# Altium schematic sheet 控制板.SchDoc (part 1 of 2) (continued)
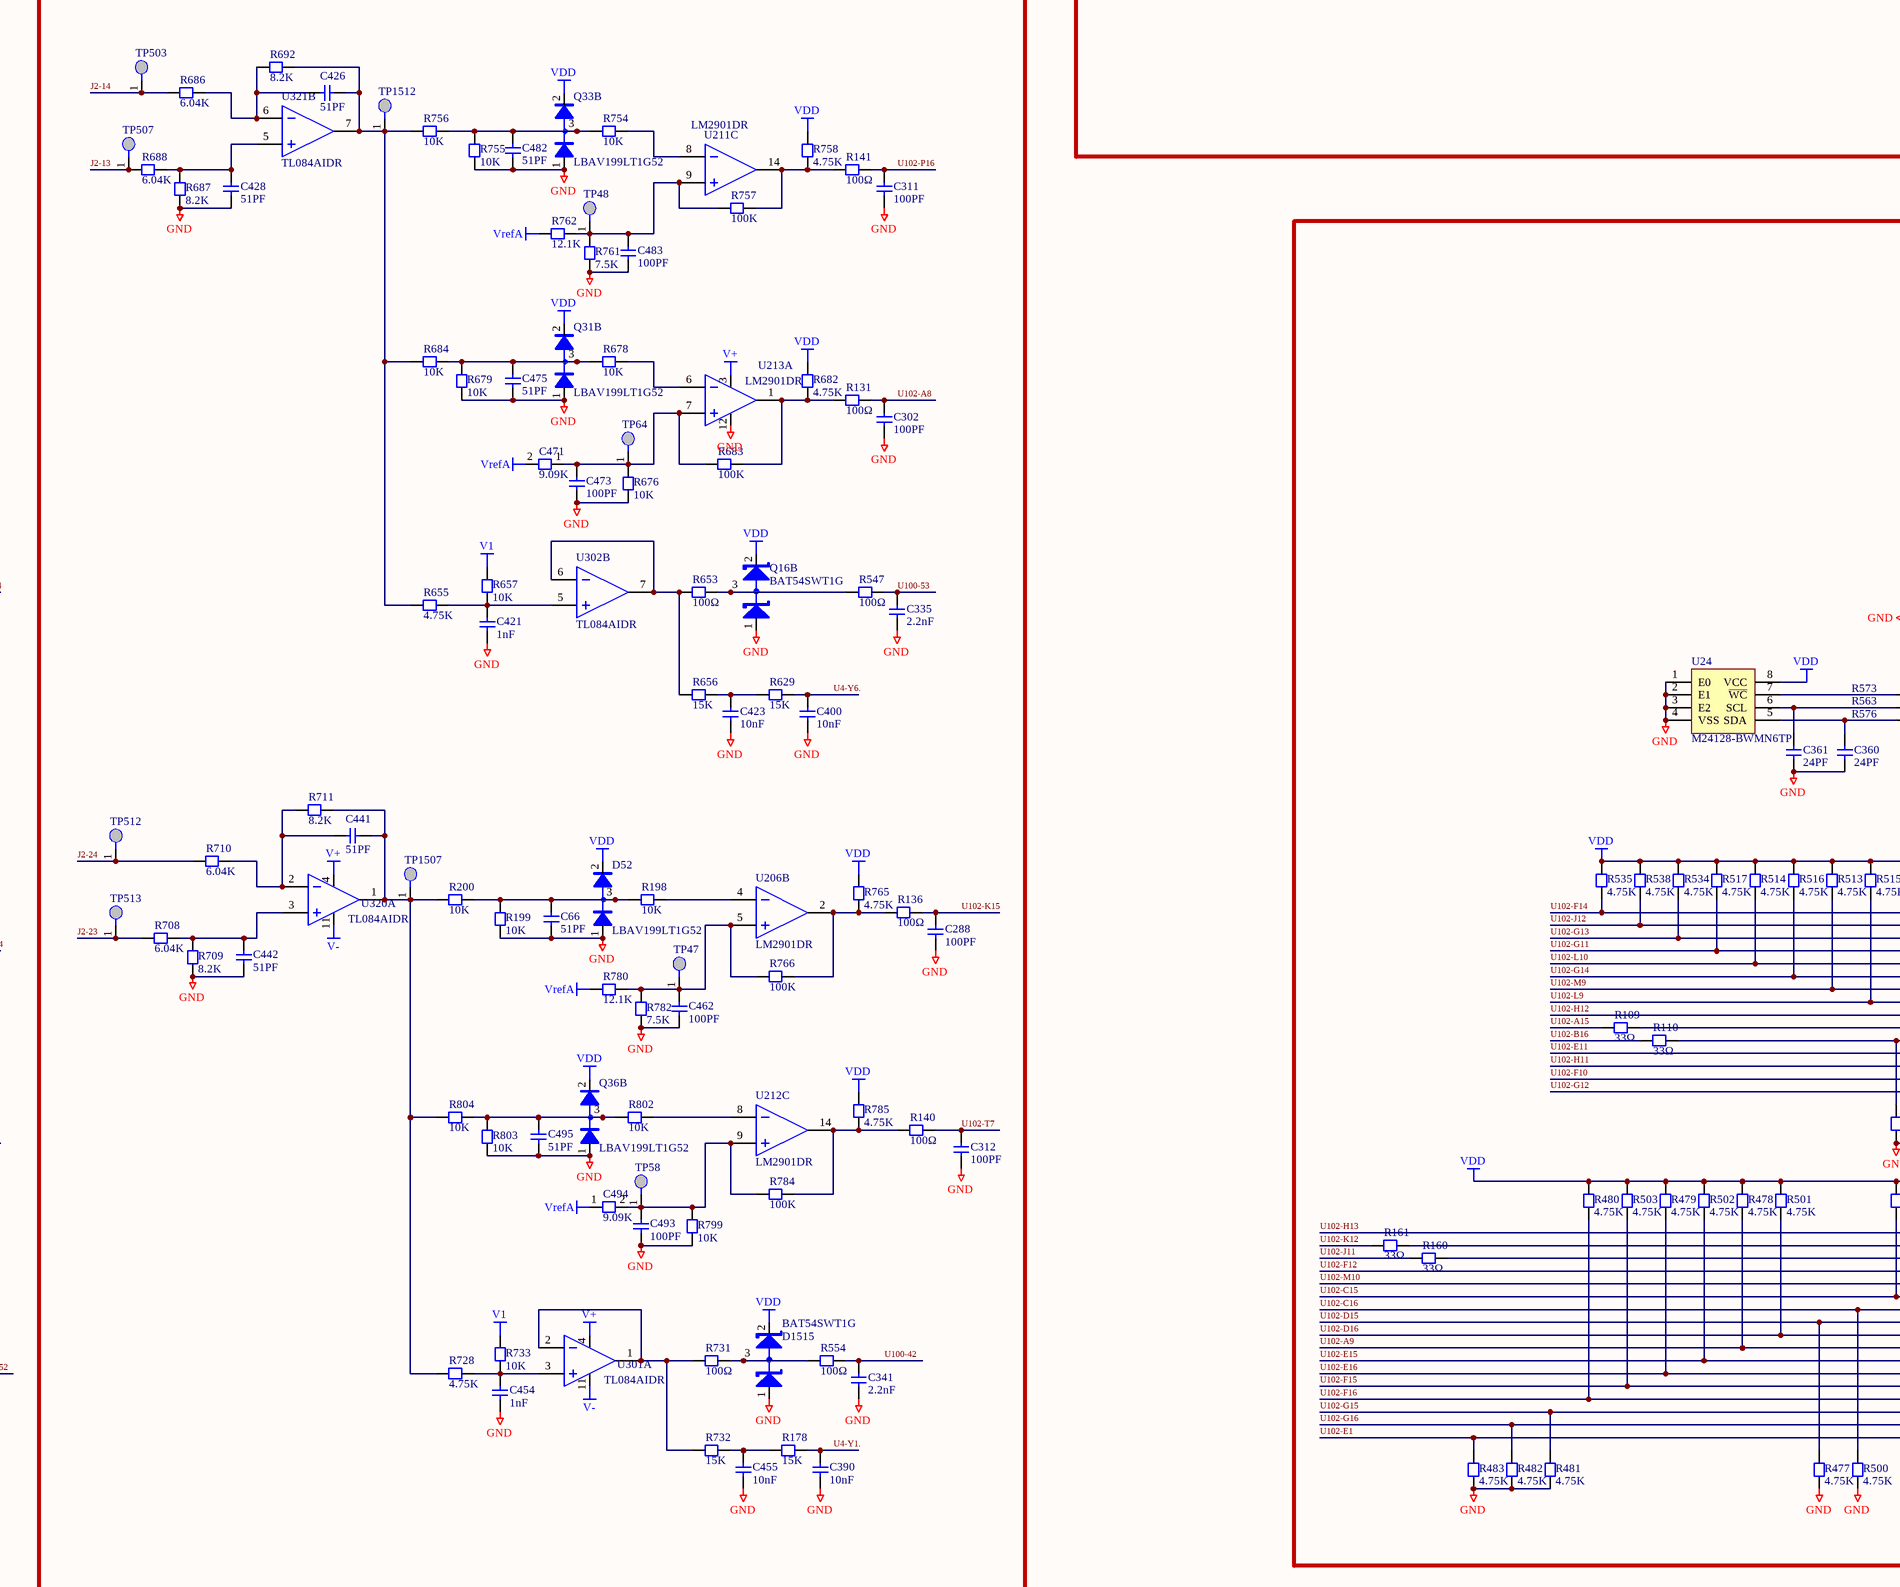
[diagram p5: 控制板.SchDoc, centre column 2 of 4]
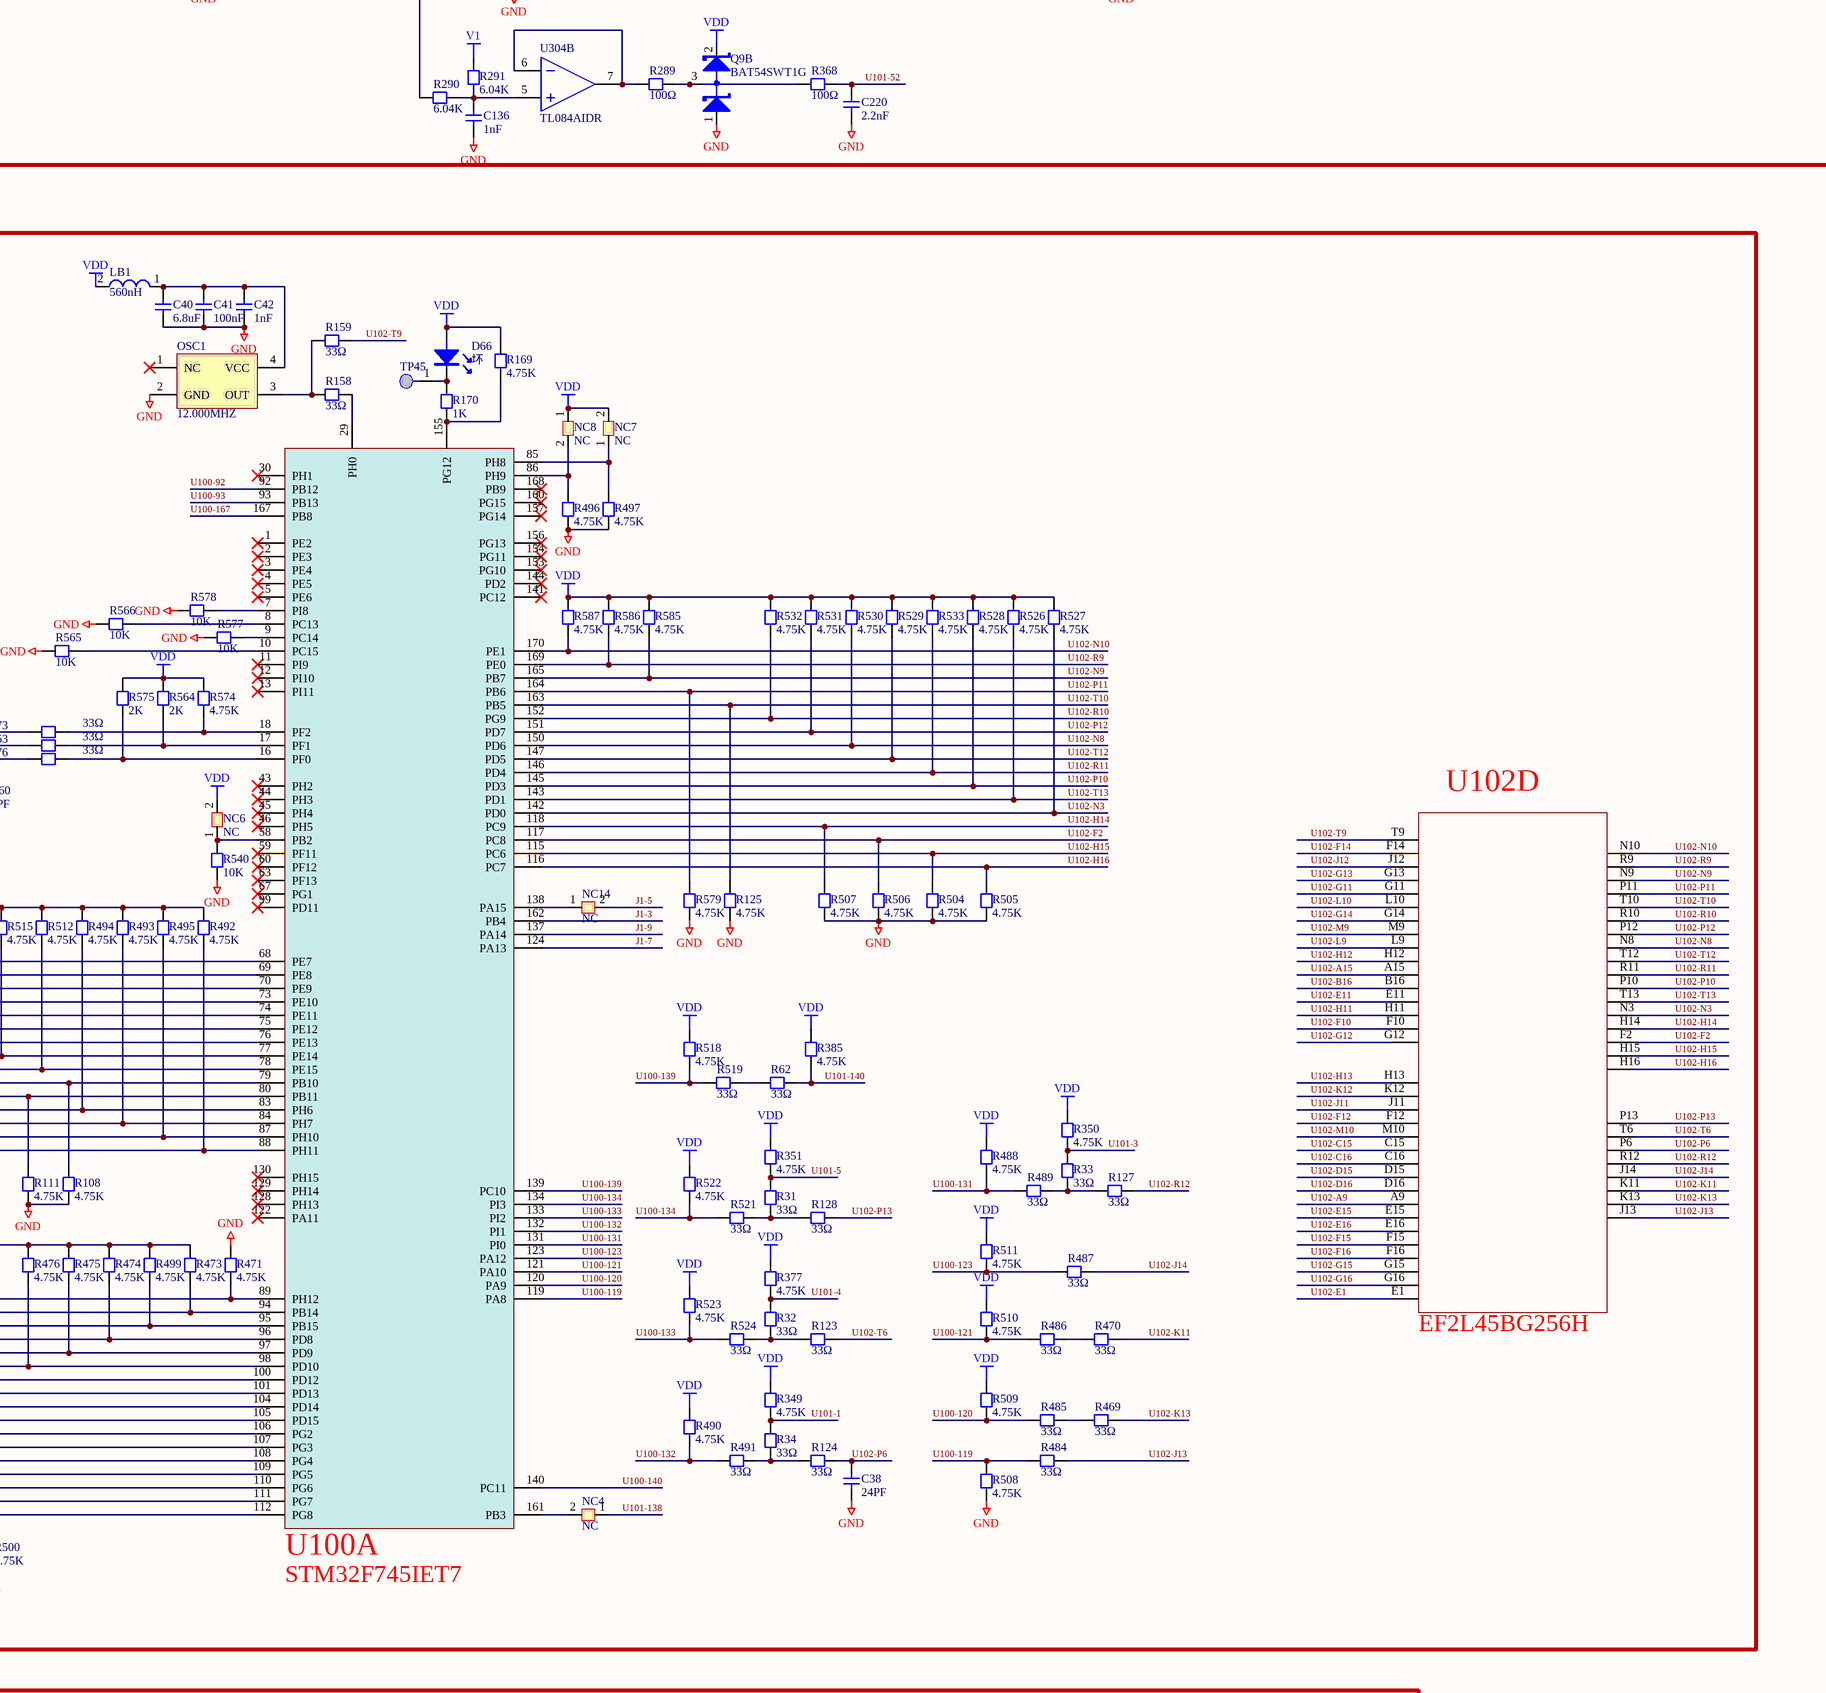
[diagram p6: 控制板.SchDoc, centre column 3 of 4]
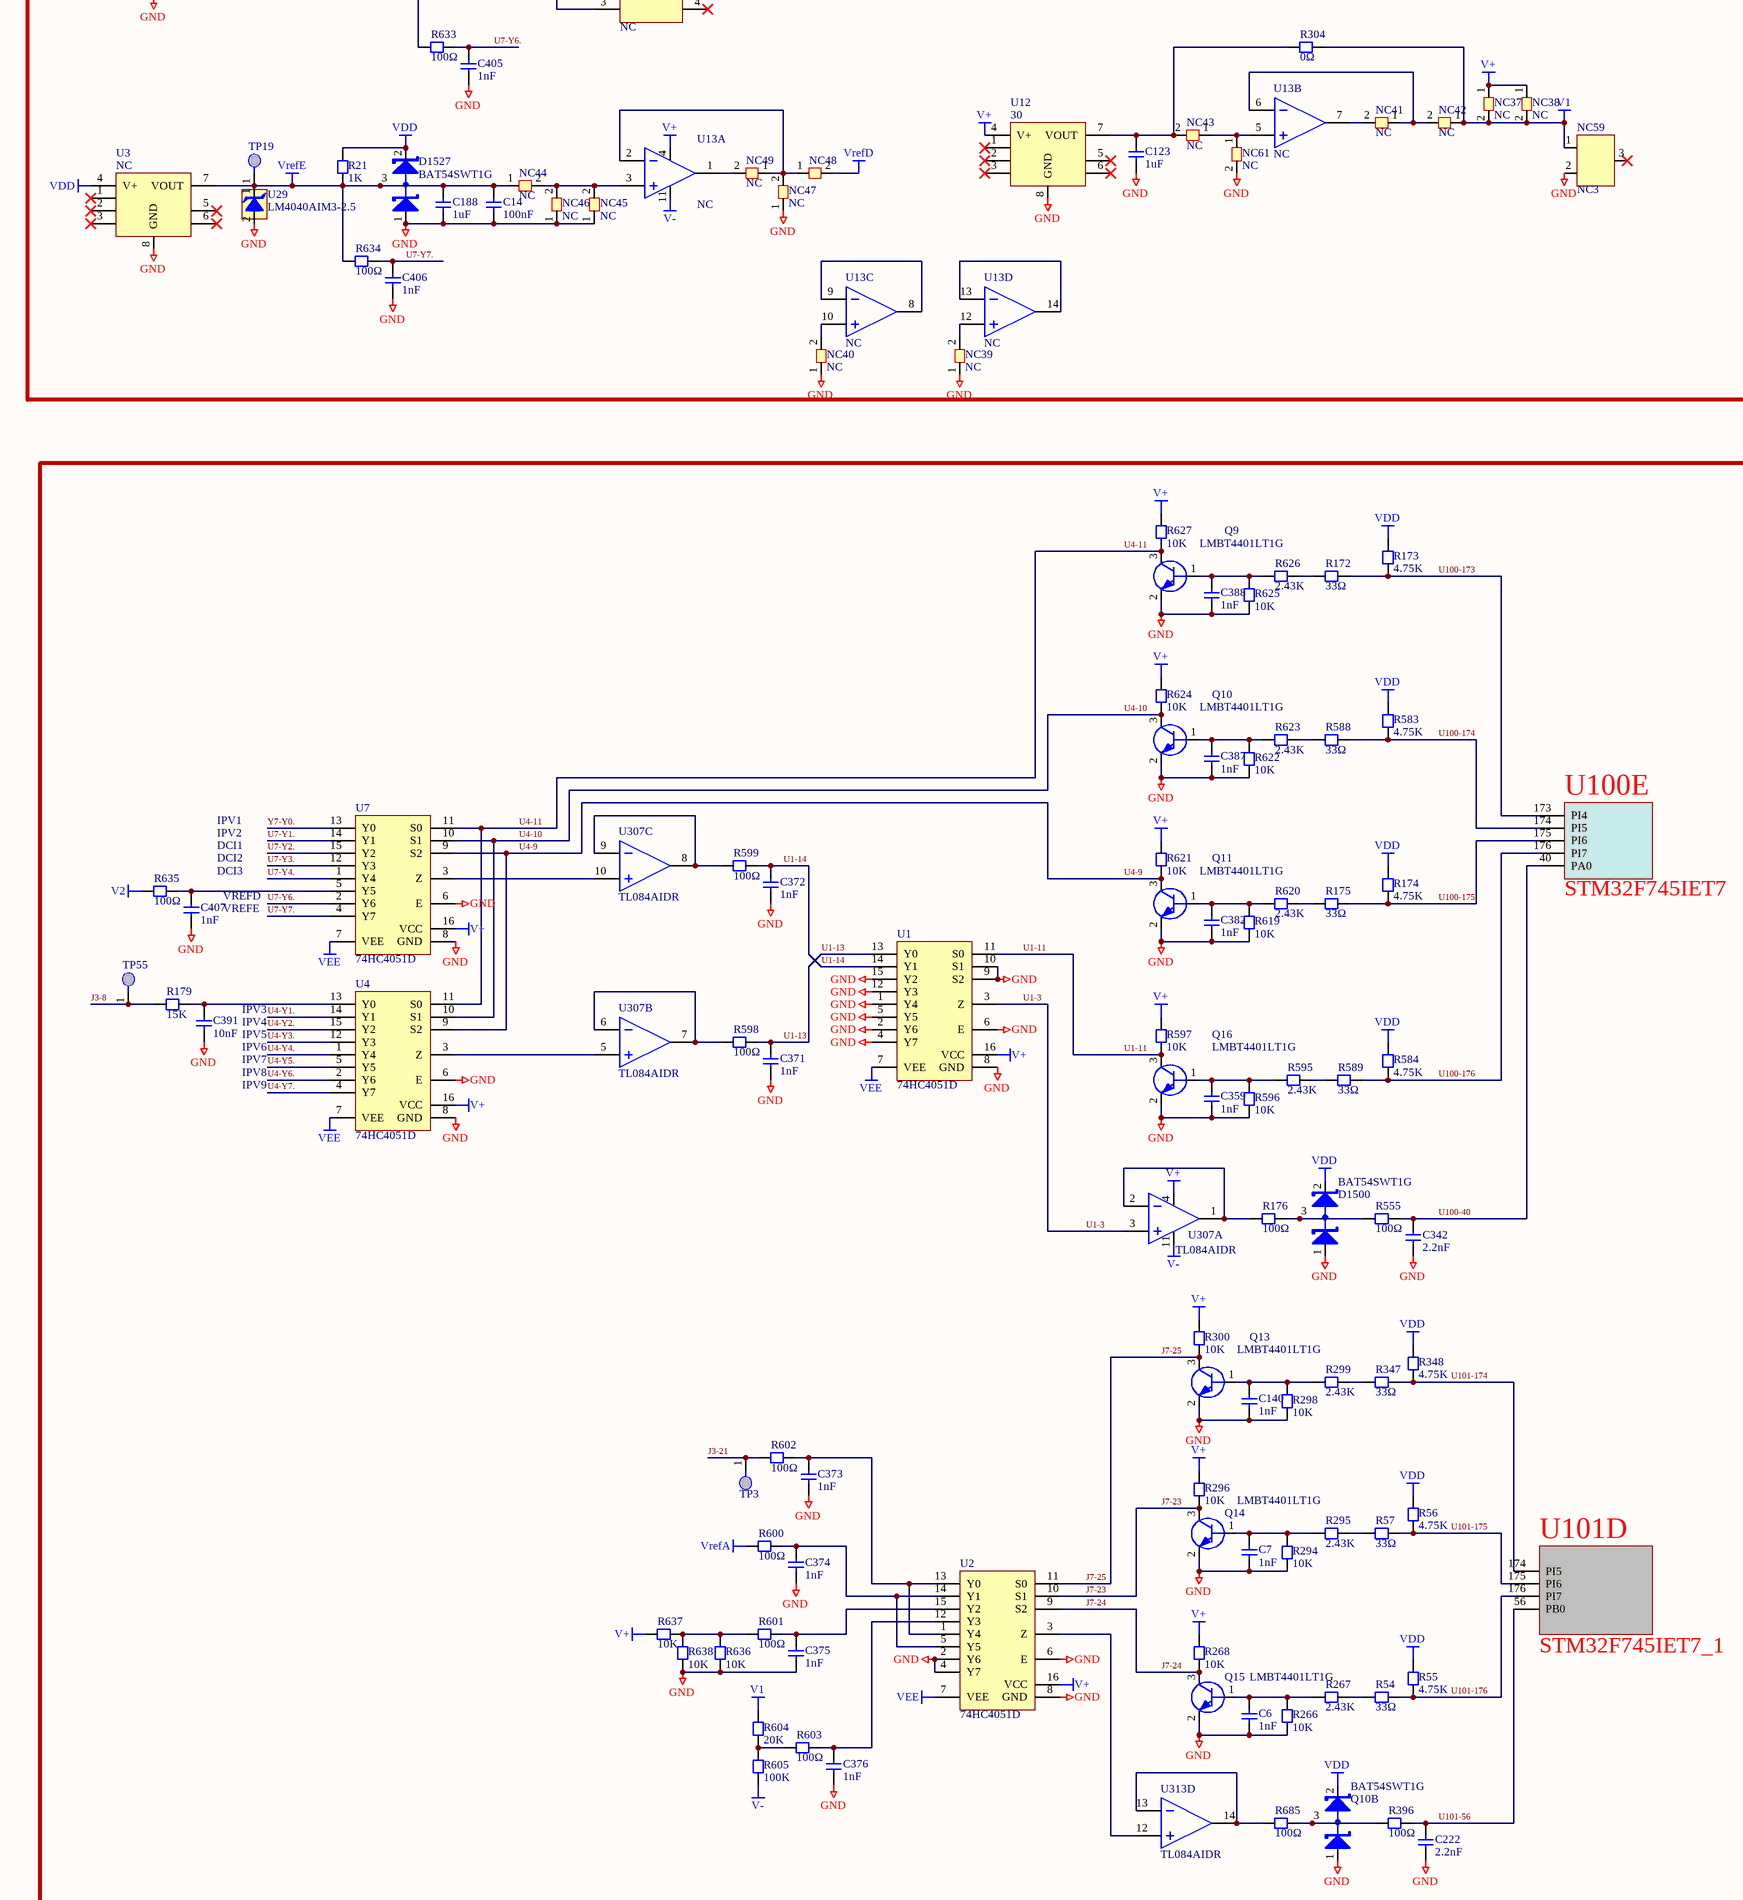
[diagram p7: 控制板.SchDoc, centre column 4 of 4]
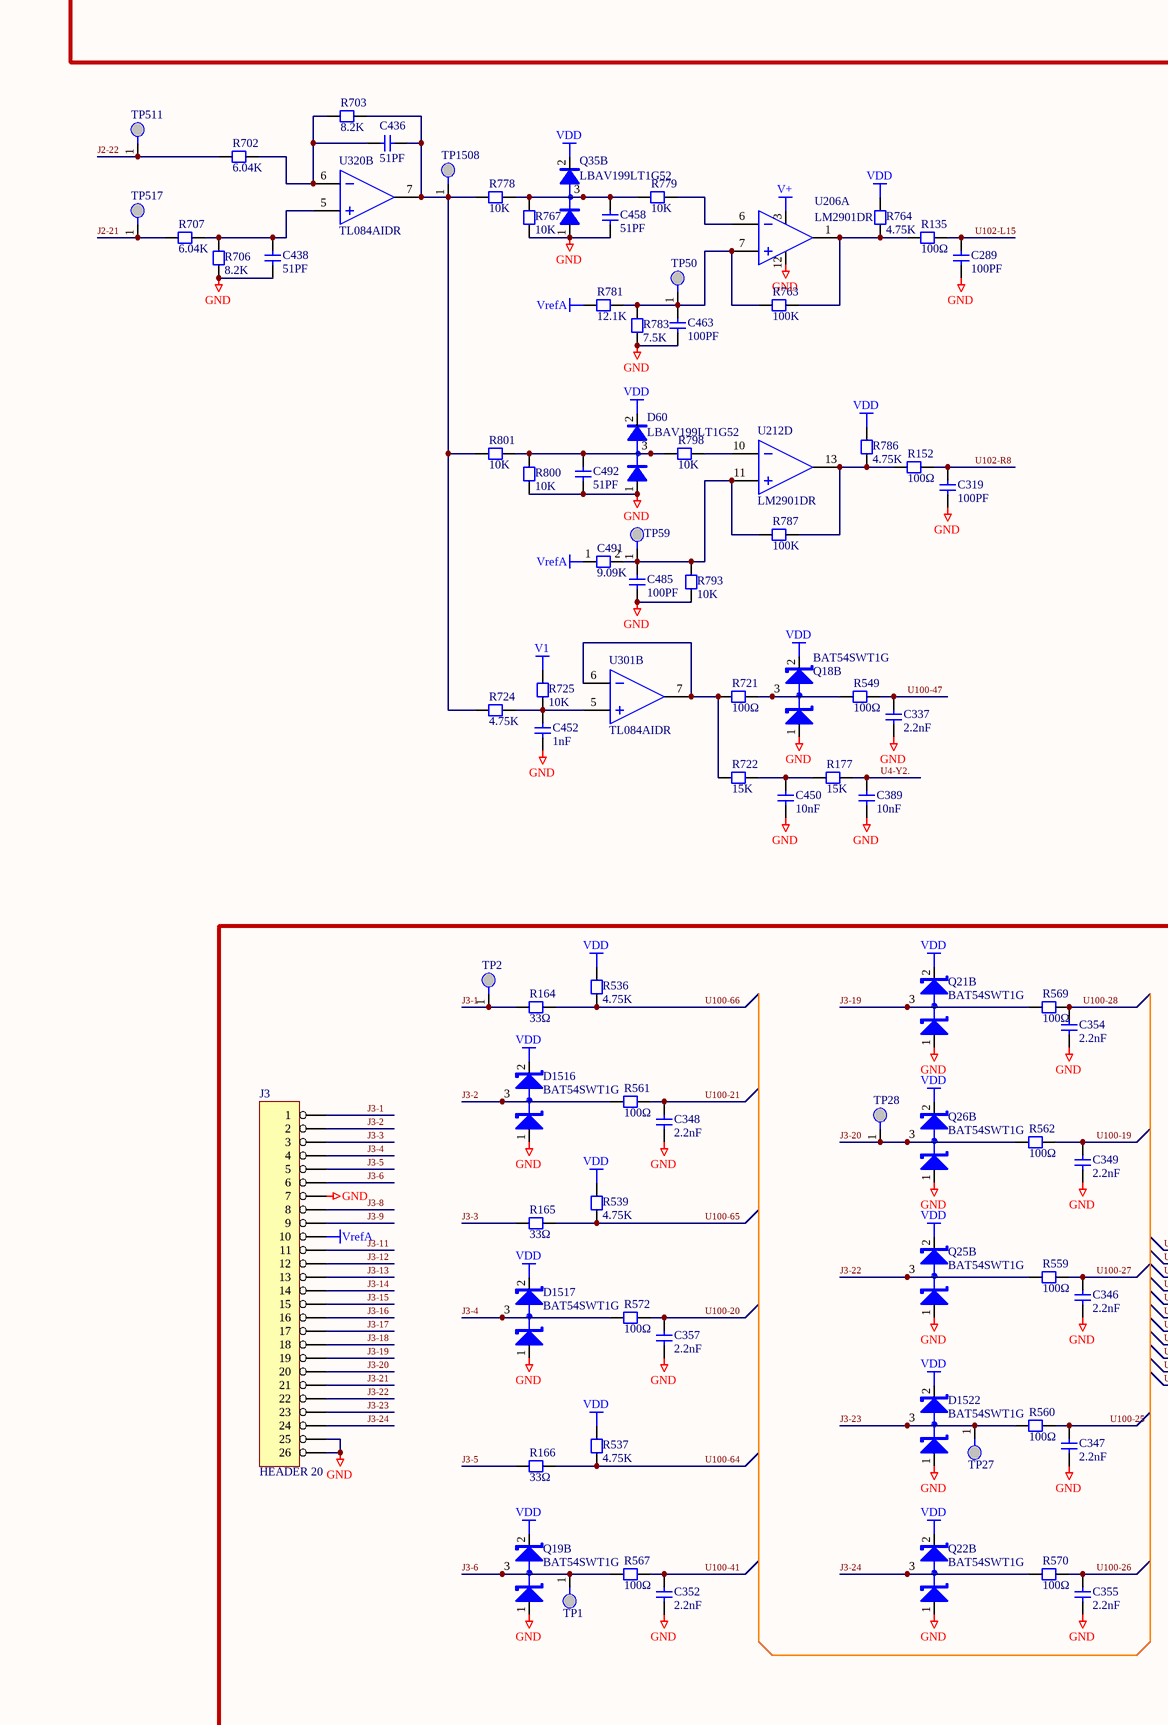
[diagram p8: 控制板.SchDoc, bottom column 1 of 4]
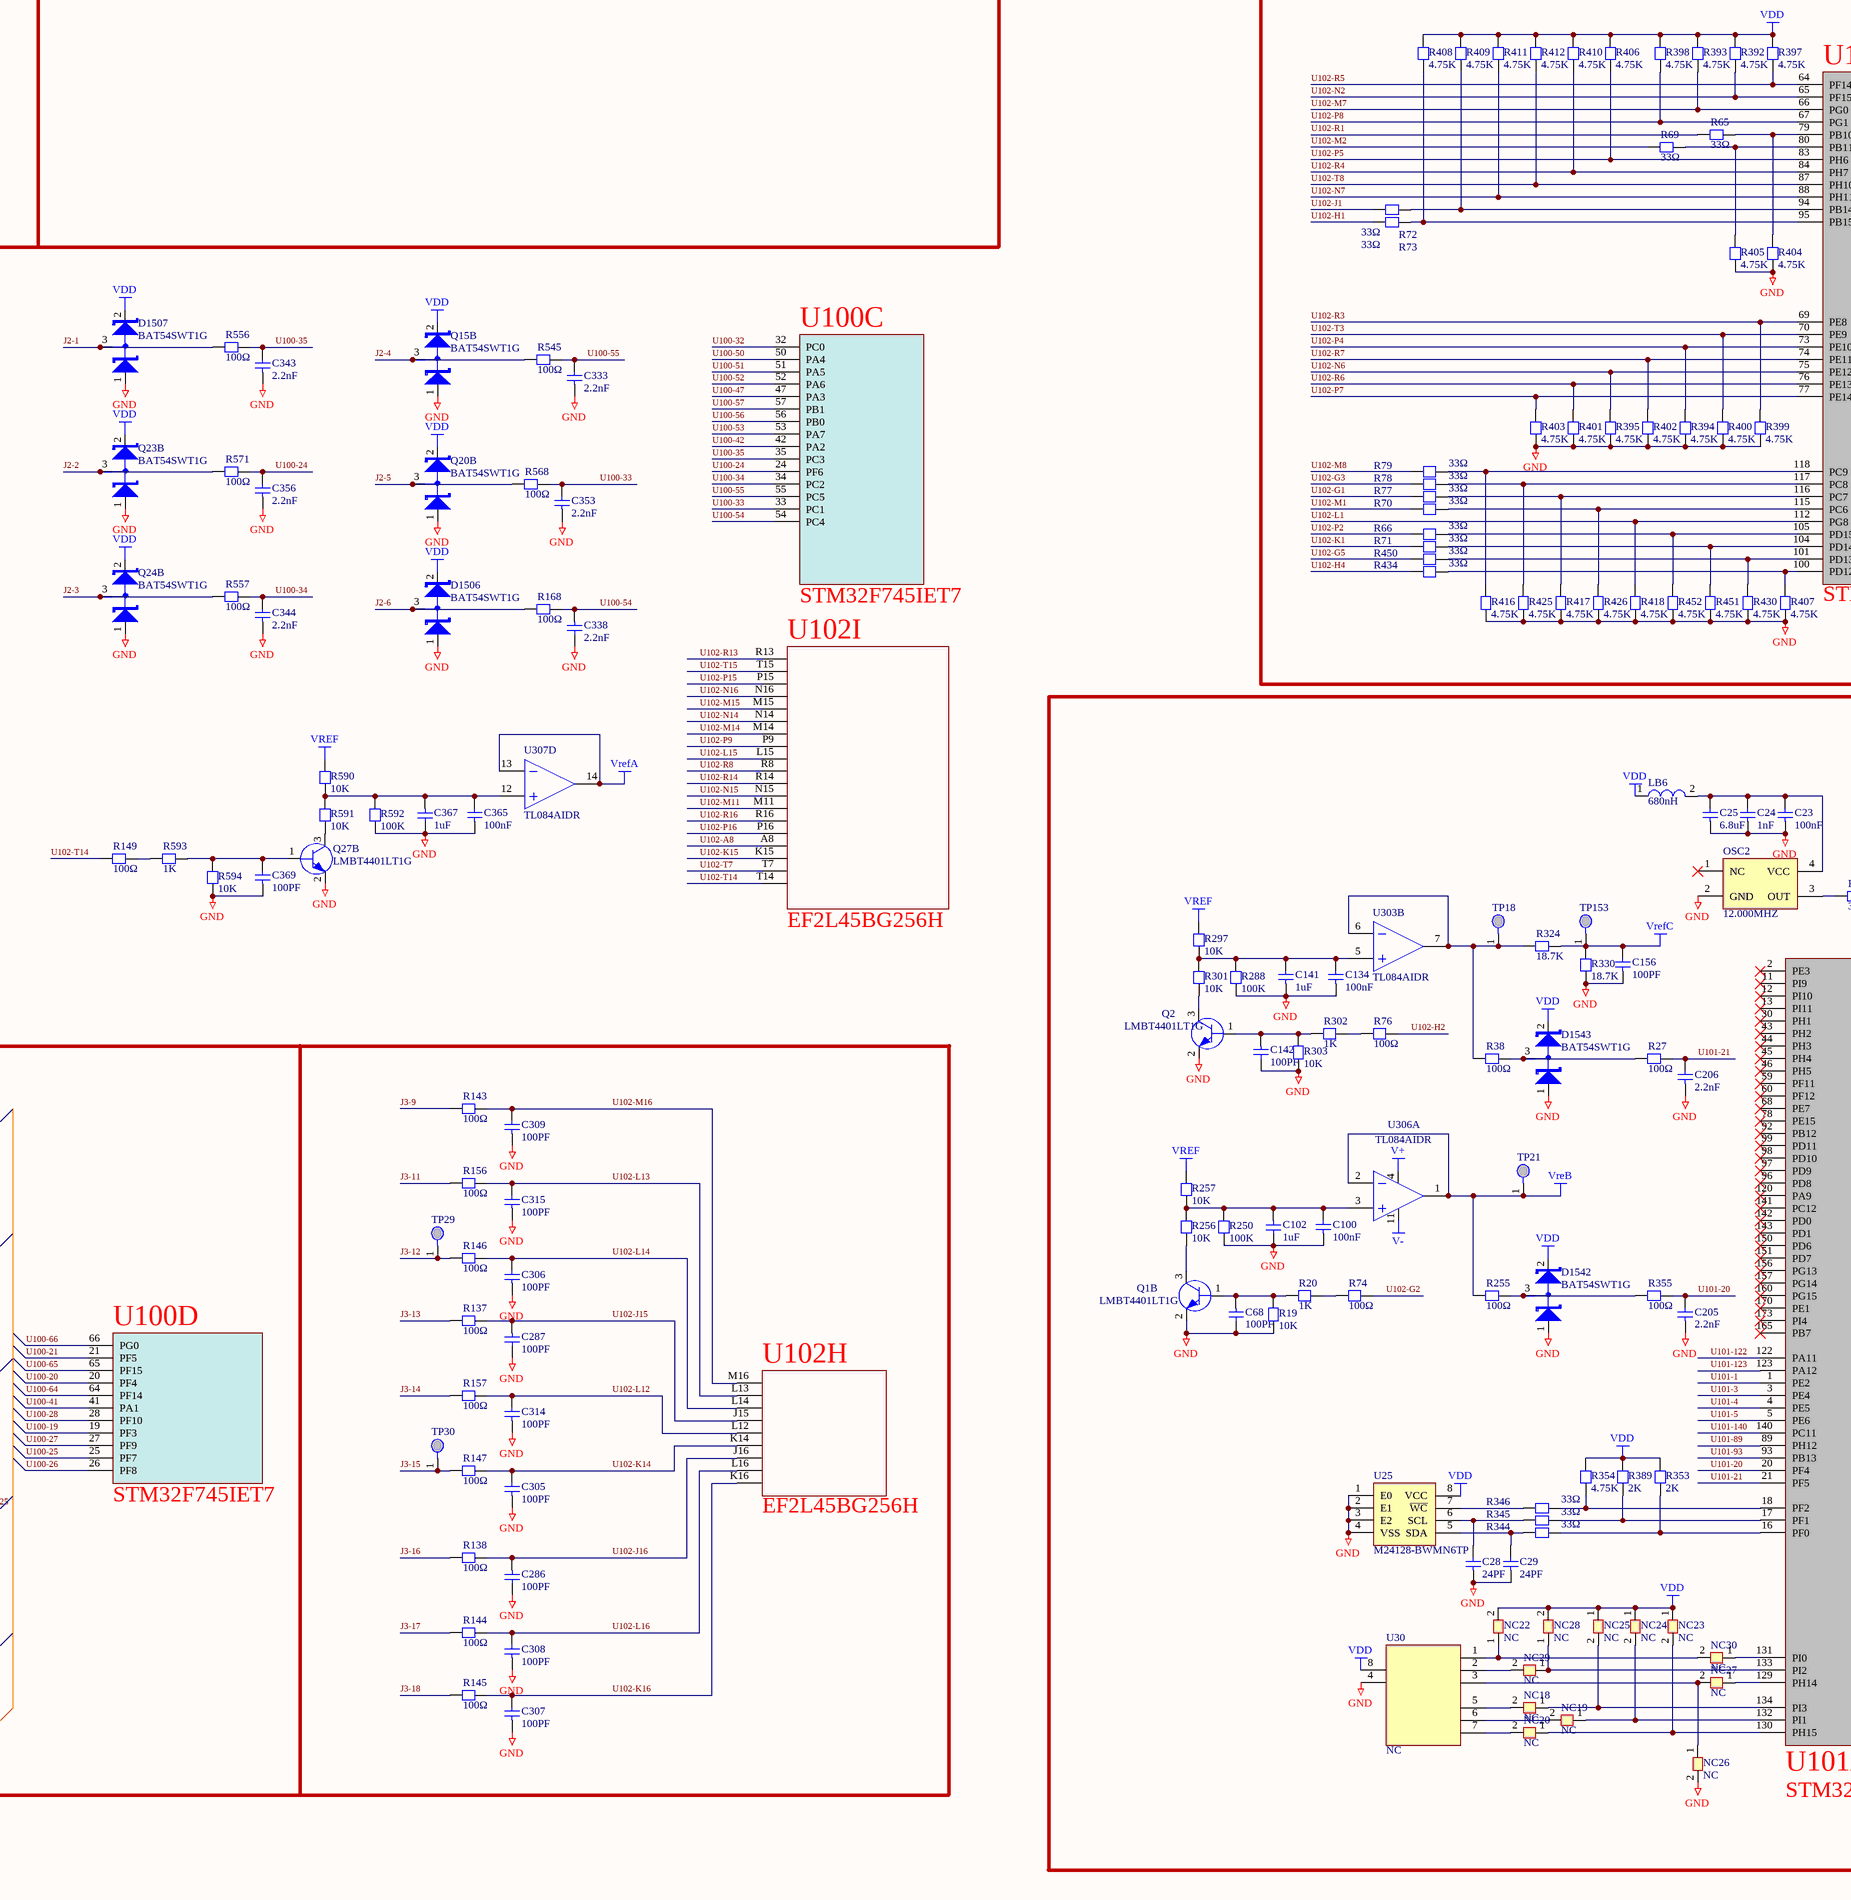
[diagram p9: 控制板.SchDoc, bottom column 2 of 4]